# EasyEDA Pro project 第十五届蓝桥杯EDA赛项模拟试题二（嘉立创EDA提供）.eprj, board PCB-PockerMultimater1 (continued)
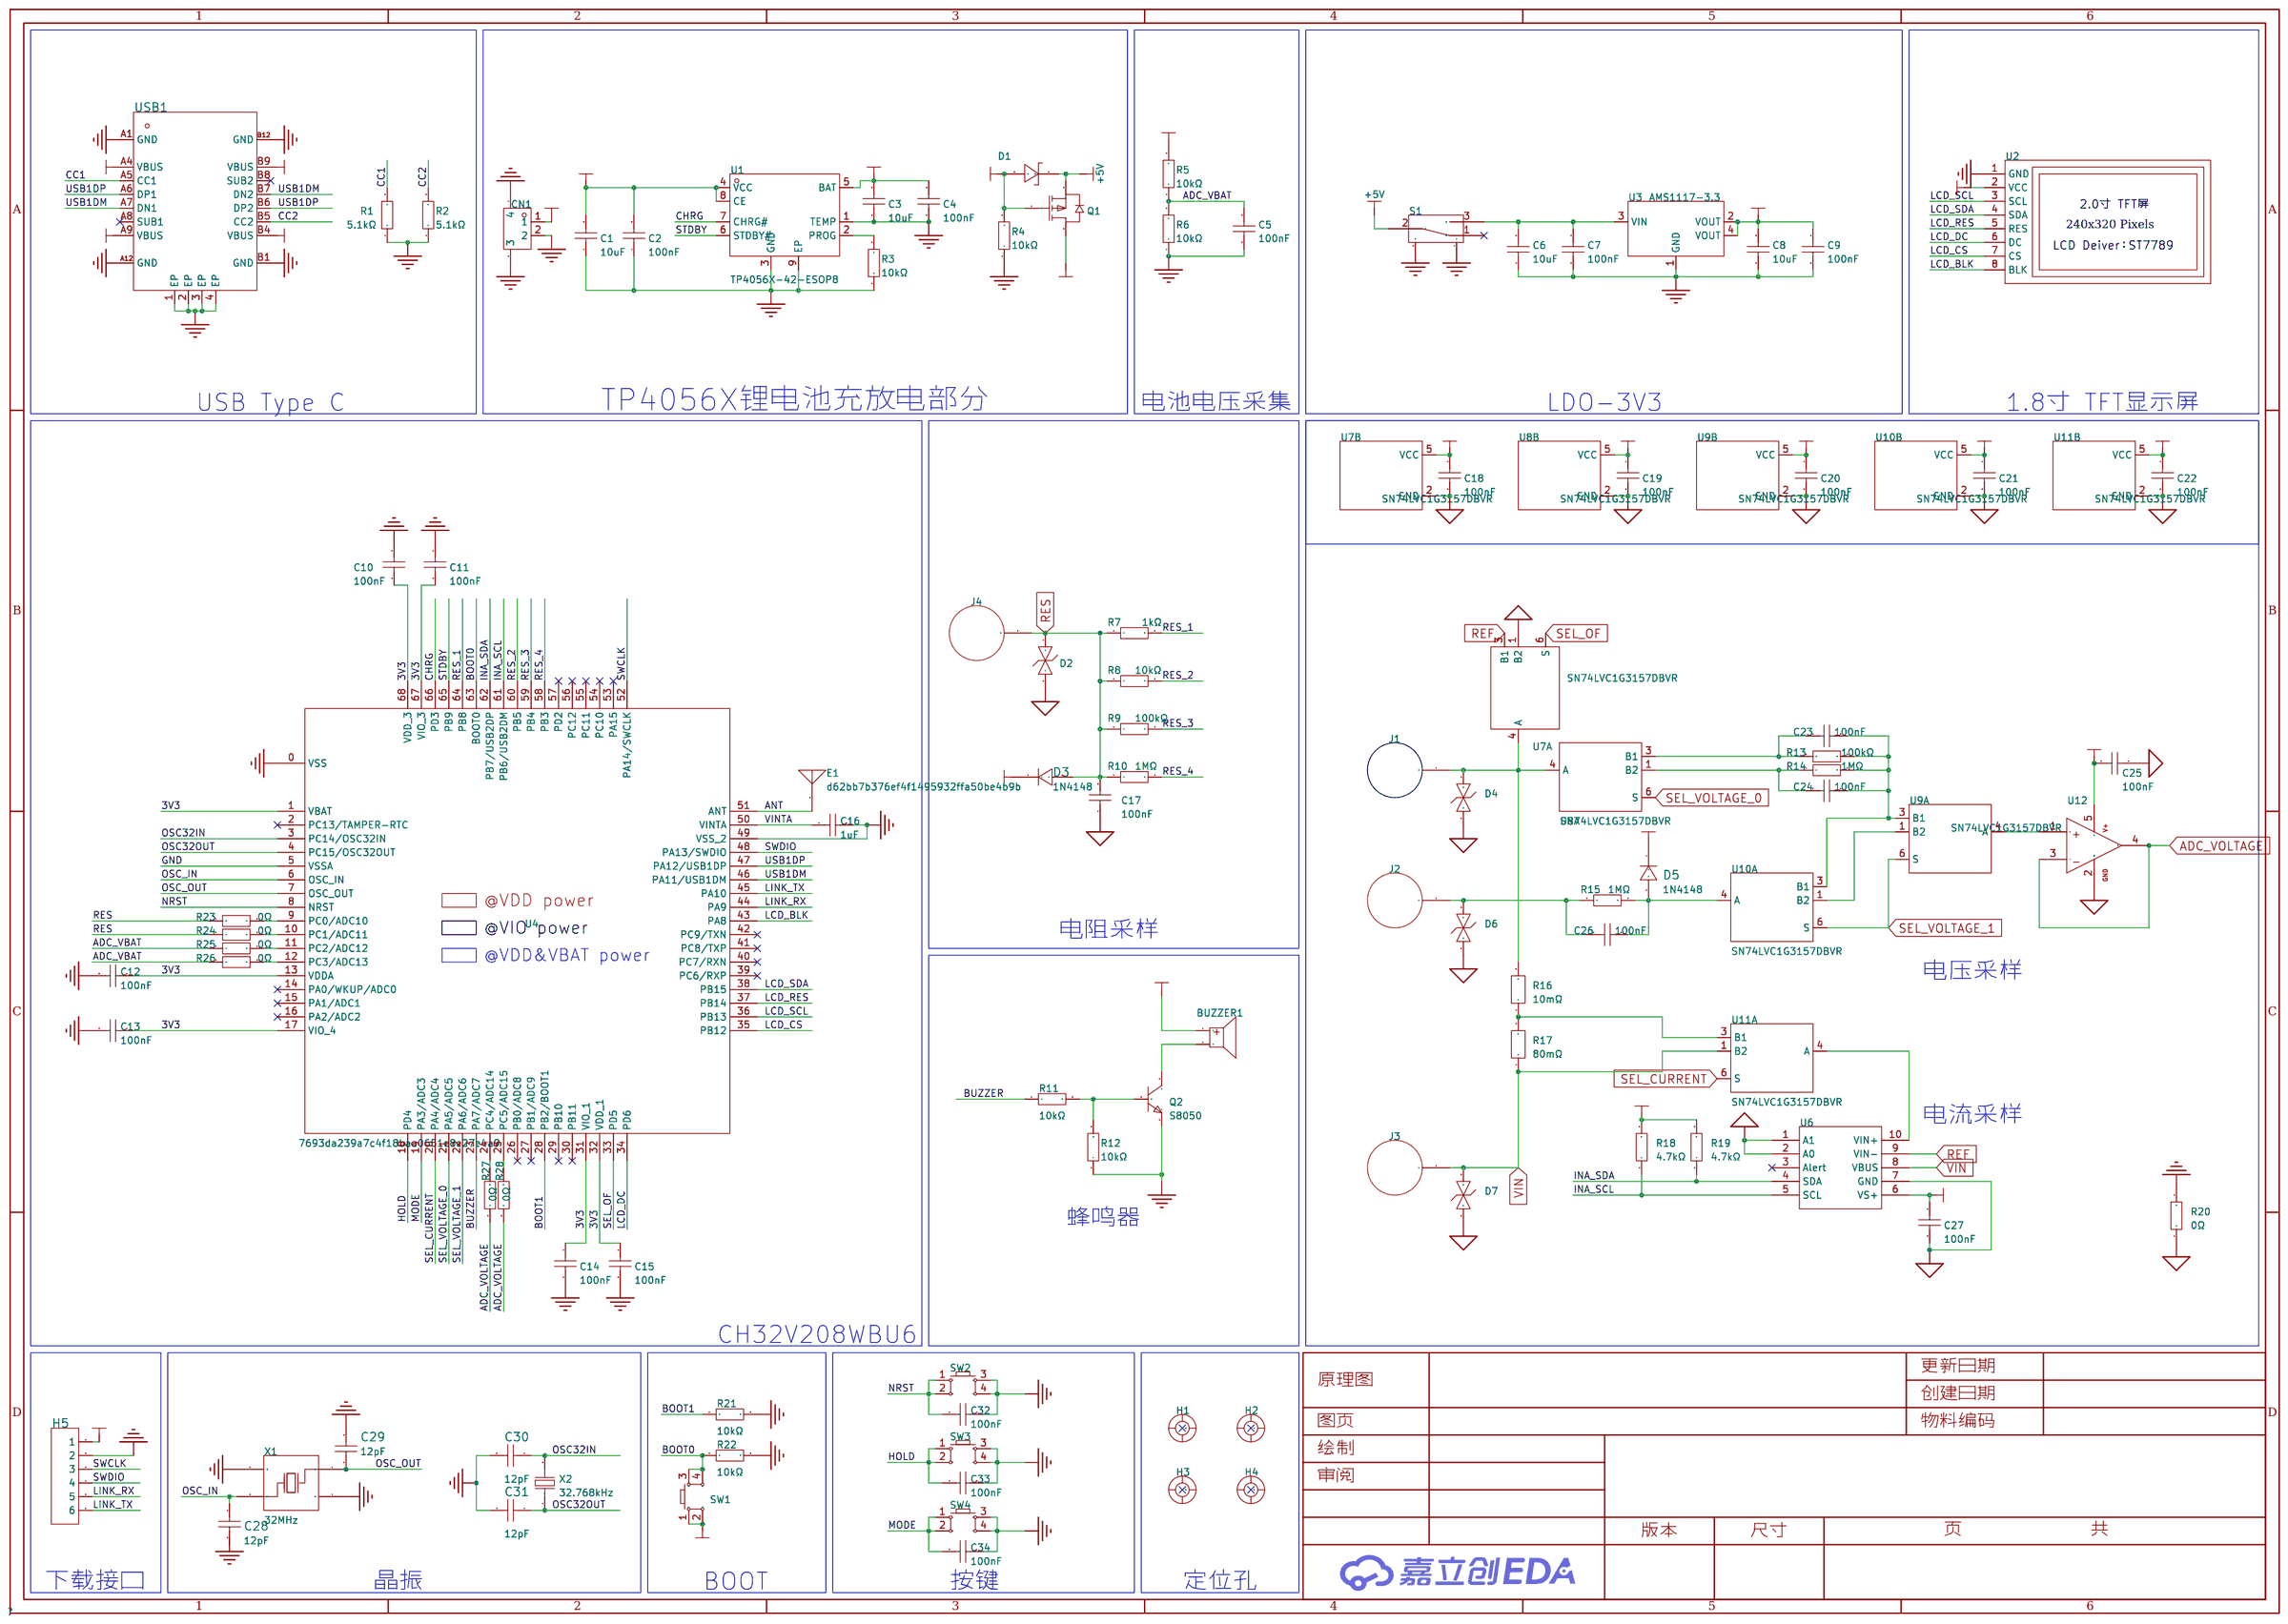
[diagram p0: schematic sheet]
## Routing (per net, layer and track width the routed paths; a pad name or vN(x,y) marks a point on that pad's centre or on a via; arc(x,y) is an arc through that point) (continued)
  Bottom Layer w0.152: v1(18.62,50.94) 19.09,50.47 21.03,50.47 ; v1(18.57,38.33) 18.57,37.82 v1(17.63,36.88) ; v1(18.62,52.89) 21.03,50.47 ; 21.03,50.47 v1(22.02,50.47)
  vias: v1(10.13,1.98) v1(13.92,16.15) v1(15.52,13.66) v1(17.22,19.53) v1(17.5,20.52) v1(18.64,45.19) v1(19.48,21.62) v1(20.22,2.46) v1(22.07,37.54) v1(22.1,26.31) v1(22.17,44.88) v1(22.17,42.83) v1(22.17,34.85) v1(22.17,21.95) v1(22.28,24.05) v1(22.53,29.39) v1(22.58,19.3) v1(23.62,22.66) v1(23.62,20.88) v1(23.62,18.73) v1(24.66,48.78) v1(25.53,47.68) v1(25.65,44.88) v1(25.65,42.57) v1(26.34,45.96) v1(27.33,45.39) v1(27.33,42.54) v1(30.1,45.52) v1(30.1,42.62) v1(31.75,29.54) v1(31.76,23.39) v1(32.41,28.04) v1(33.5,23.65) v1(33.81,16.79) v1(34.52,29.54) v1(34.7,2.51) v1(35.23,27.79) v1(35.97,48.92) v1(36.47,23.37) v1(36.93,16.69) v1(38.3,48.95) v1(39.5,46.18) v1(39.92,23.37) v1(41.05,46.18) v1(41.33,44.32) v1(43.38,49.07) v1(43.89,24.66) v1(43.94,19.41) v1(44.12,27.99) v1(44.96,46.91) v1(45.26,40.64) v1(45.31,21.54) v1(45.57,30.76) v1(45.67,24.87) v1(45.95,27.48) v1(46.05,28.73) v1(46.38,48.99) v1(46.79,16.51) v1(47.19,46.91) v1(47.5,45.47) v1(49.05,31.67) v1(48.99,24.87) v1(49.1,27.99) v1(49.33,9.55) v1(49.99,30.33) v1(50.09,1.55) v1(50.29,46.91) v1(50.27,33.43) v1(50.39,26.06) v1(50.52,43.89) v1(50.77,40.72) v1(50.93,38.91) v1(51.14,45.47) v1(51.18,36.73) v1(51.41,49.02) v1(57.95,15.43) v1(58.98,20.62) v1(60.3,15.95) v1(61.79,13.67) v1(62.46,1.93) v1(63.19,18.72) v1(64.39,13.67) v1(65.96,10.11) v1(67.59,12.32)
GND: length 177.2
  Top Layer w0.152: 14.14,27.98 v1(14.88,27.98) ; 14.14,27.98 R4.1 12.23,27.95 C2.1 12.15,27.91 C1.1 ; 14.14,27.98 13.57,27.98 ; X1.2 20.5,75.7 v1(20.76,75.44) ; v1(7.26,54.22) 7.26,54.23 ; 41.15,79.15 41.45,79.15 v1(41.96,79.65) v1(43.08,80.77) v1(44.59,82.28) v1(46.17,83.87) v1(47.95,85.64) v1(49.35,87.05) v1(50.81,88.51) v1(51.91,89.6) v1(53.62,91.31) v1(55.3,91.31) v1(56.7,91.31) v1(58.14,91.31) v1(59,92.18) v1(59,93.19) ; C3.1 v1(8.54,31.19) ; C6.1 8.93,52.84 C7.2 ; v1(17.76,80.12) v1(17.04,79.4) v1(17.04,76) 17.6,75.44 v1(19.03,75.44) v1(20.76,75.44) ; v1(17.76,80.12) 18.3,79.59 X1.4 ; v1(17.76,80.12) v1(19.55,80.12) v1(21.3,80.12) v1(23.87,80.12) ; USB1.B1 v1(8.56,15.95) ; 39.01,79.86 v1(39.9,79.86) v1(41,80.95) v1(41.9,81.85) v1(43.07,83.03) v1(44.35,84.31) v1(45.67,85.62) v1(46.82,86.78) v1(48,87.96) v1(49.1,89.06) v1(50.42,90.38) v1(51.53,91.48) 52.5,92.46 v1(52.98,92.46) v1(55.07,92.46) 56.67,92.46 v1(56.97,92.76) v1(56.97,94.08) ; v1(27.48,76.25) 27.46,76.28 v1(25.7,76.28) 24.52,76.28 24.24,76 24.24,75.62 v1(24.13,75.51) 22.7,75.51 22.65,75.46 ; C29.1 22.05,75.59 21.9,75.44 v1(20.76,75.44) ; C12.2 28.08,73.49 v1(28.08,70.65) 28.07,70.64 27.97,70.64 ; v1(23.87,80.12) 24.13,79.86 24.13,78.84 25.21,77.76 v1(25.35,77.76) 25.5,77.6 U4.5 ; v1(23.87,80.12) 23.88,80.13 v1(23.88,81.81) 23.7,81.99 C31.2 v1(21.25,81.99) v1(20.3,81.99) 19.66,82.63 v1(19.66,83.74) v1(19.66,85.41) v1(19.66,86.94) 20.2,87.49 v1(21.06,87.49) C30.2 v1(24.02,87.49) v1(24.64,86.87) 24.64,86.23 25.2,85.67 v1(25.58,85.67) 25.69,85.57 v1(25.69,84.14) v1(25.69,82.63) v1(25.69,81.08) 25.69,80.28 v1(26.39,79.58) 27.69,79.58 v1(27.71,79.55) 28.42,79.55 ; R20.2 15.01,40.78 C8.1 16.67,41.64 C9.2 ; U4.49 37.4,78.4 U4.0 ; 10.97,17.28 v1(12.14,17.28) ; R12.1 63.93,25.8 Q2.2 ; v1(14.61,37.27) C5.2 13.05,37.14 13.05,35.52
  Top Layer w0.508: v1(58.69,41.58) 60.19,41.58 SW3.3 ; SW2.3 60.01,49.76 v1(58.21,49.76) ; C16.2 v1(45.9,79.81) ; 7.27,22.17 v1(8.67,22.17) ; v1(60.81,25.78) 62.24,25.78 R12.1 ; 8.47,31.92 10.32,31.92 10.35,31.95 ; SW4.3 60.16,33.34 v1(58.54,33.34) ; v1(2.28,27.14) 2.28,28.52 CN1.3 2.2,30.2 2.7,30.69 CN1.2 5.88,30.67 v1(7.89,30.67) ; v1(12.14,20.29) 11,20.29 R1.1 ; 30.45,84.35 v1(30.43,84.33) C11.1 32.11,83.07 C10.2 ; SW3.4 68.56,41.55 v1(68.56,40.1) ; v1(68.66,32.09) 68.66,33.29 SW4.4 ; C6.1 v1(7.26,54.22) ; v1(68.46,48.34) 68.46,49.76 SW2.4 ; R22.2 19.59,97.28 v1(18.75,97.28) ; C15.2 38.54,66.47 R21.2 v1(35.25,65.49) 35.28,65.46 ; U3.1 13.58,51.05 ; CN1.4 2.2,36.48 ; C34.1 v1(63.3,39.69) ; C32.1 v1(62.43,56.11)
  Bottom Layer w0.152: v1(58.69,41.58) 58.54,41.43
  vias: v1(2.2,36.68) v1(3.1,64.69) v1(3.1,63.91) v1(3.43,10.16) v1(3.43,9.37) v1(4.19,64.69) v1(4.19,63.91) v1(4.52,10.16) v1(4.52,9.37) v1(5.51,83.72) v1(5.51,82.93) v1(5.56,77.01) v1(5.56,76.23) v1(6.6,83.72) v1(6.6,82.93) v1(6.65,77.01) v1(6.65,76.23) v1(7.92,38.63) v1(7.92,37.85) v1(9.01,38.63) v1(9.01,37.85) v1(11.84,39.88) v1(11.84,39.09) v1(12.92,39.88) v1(12.92,39.09) v1(12.95,97.33) v1(12.95,96.55) v1(13.16,79.48) v1(13.16,78.69) v1(13.23,74.14) v1(13.23,73.36) v1(13.31,87.5) v1(13.31,86.72) v1(13.39,83.36) v1(13.39,82.58) v1(13.58,51.25) v1(13.79,61.16) v1(13.79,60.38) v1(14.04,97.33) v1(14.04,96.55) v1(14.24,79.48) v1(14.24,78.69) v1(14.32,74.14) v1(14.32,73.36) v1(14.4,87.5) v1(14.4,86.72) v1(14.47,83.36) v1(14.47,82.58) v1(14.55,54.99) v1(14.55,54.2) v1(14.88,61.16) v1(14.88,60.38) v1(15.47,46.99) v1(15.47,46.2) v1(15.64,54.99) v1(15.64,54.2) v1(16.56,46.99) v1(16.56,46.2) v1(20.07,62) v1(20.07,61.21) v1(21.15,62) v1(21.15,61.21) v1(24.13,78.81) v1(40.79,88.44) v1(40.79,87.66) v1(41.88,88.44) v1(41.88,87.66) v1(43.08,92.53) v1(43.08,91.75) v1(43.59,97.33) v1(43.59,96.55) v1(44.16,92.53) v1(44.16,91.75) v1(44.32,64.52) v1(44.32,63.73) v1(44.67,97.33) v1(44.67,96.55) v1(45.03,89.51) v1(45.03,88.72) v1(45.41,64.52) v1(45.41,63.73) v1(46.12,89.51) v1(46.12,88.72) v1(47.02,61.16) v1(47.02,60.38) v1(47.75,65.18) v1(47.75,64.39) v1(48.1,61.16) v1(48.1,60.38) v1(48.84,65.18) v1(48.84,64.39) v1(53.03,85.67) v1(53.03,84.89) v1(53.8,65) v1(53.8,64.21) v1(54.12,85.67) v1(54.12,84.89) v1(54.88,65) v1(54.88,64.21) v1(56.08,69.75) v1(56.08,68.96) v1(56.16,60.76) v1(56.16,59.97) v1(57.12,87.86) v1(57.12,87.07) v1(57.17,69.75) v1(57.17,68.96) v1(57.25,60.76) v1(57.25,59.97) v1(57.86,44.14) v1(57.86,43.36) v1(58.21,87.86) v1(58.21,87.07) v1(58.19,63.7) v1(58.19,62.92) v1(58.67,84.61) v1(58.67,83.82) v1(58.95,44.14) v1(58.95,43.36) v1(59.28,63.7) v1(59.28,62.92) v1(59.36,30.56) v1(59.36,29.77) v1(59.76,84.61) v1(59.76,83.82) v1(59.84,68.35) v1(59.84,67.56) v1(60.45,30.56) v1(60.45,29.77) v1(60.93,68.35) v1(60.93,67.56) v1(63.68,23.5) v1(63.68,22.71) v1(63.88,50.24) v1(63.88,49.45) v1(64.39,35.08) v1(64.39,34.29) v1(64.44,30.3) v1(64.44,29.51) v1(64.77,43.21) v1(64.77,42.42) v1(64.76,23.5) v1(64.76,22.71) v1(64.97,50.24) v1(64.97,49.45) v1(65.47,35.08) v1(65.47,34.29) v1(65.53,30.3) v1(65.53,29.51) v1(65.86,43.21) v1(65.86,42.42) v1(66.14,58.19) v1(66.14,57.4) v1(67.23,63.86) v1(67.23,63.07) v1(67.23,58.19) v1(67.23,57.4) v1(67.31,87.12) v1(67.31,86.33) v1(67.39,81.97) v1(67.39,81.18) v1(67.49,92.02) v1(67.49,91.24) v1(67.49,74.8) v1(67.49,74.02) v1(68.25,28.45) v1(68.25,27.66) v1(68.32,63.86) v1(68.32,63.07) v1(68.4,87.12) v1(68.4,86.33) v1(68.47,81.97) v1(68.47,81.18) v1(68.57,92.02) v1(68.57,91.24) v1(68.57,74.8) v1(68.57,74.02) v1(69.34,28.45) v1(69.34,27.66)
VBAT: length 2.2
  Top Layer w0.508: 8.57,35.42 8.49,35.5 ; C3.2 8.54,35.42
  vias: v1(5,33.96) v1(5.03,33.17) v1(6.28,33.94) v1(6.28,33.17) v1(7.38,33.94) v1(7.39,33.17) v1(15.98,24.51) v1(15.98,23.65) v1(15.98,22.86)
VBUS: length 13.6
  Top Layer w0.152: U1.8 13.08,29.55
  Top Layer w0.508: U1.4 18.5,33.36 19.05,32.82 19.05,27.25 18.24,26.45 R4.2
  vias: v1(9.14,29.26) v1(9.14,28.09) v1(9.09,27.22)
VIN: length 41.1
  Top Layer w0.152: U6.8 43.63,38.56 43.64,38.56 43.64,37.16 43.35,36.87 U11.1
  Top Layer w0.508: v1(41.81,17.6) 41.81,15.81 41.8,15.8 41.8,8.53 J3.1 ; U11.1 41.19,36.87 40.67,36.35 40.67,30.91 40.31,30.56 38.35,30.56 38.06,30.26 v1(38.06,29.84) v1(38.06,28.91) v1(38.06,27.98) R17.1
  Bottom Layer w0.508: v1(38.06,27.98) 38.06,18.69 39.14,17.6 v1(41.81,17.6)
VINTA: length 5.6
  Top Layer w0.152: 44.56,78.8 U4.50
ADC_VBAT: length 51.9
  Top Layer w0.152: R26.1 21.94,69.68 R25.1 17.54,70.76 16.71,69.94 v1(16.71,67.46) ; v1(16.71,61.92) 19.69,58.95 19.69,38.15 19.02,37.49 16.03,37.49 15.57,37.95 12.15,37.95 11.52,37.32
  Top Layer w0.508: C5.1 11.52,35.55 R6.2 10,35.52 9.98,35.5
  Bottom Layer w0.152: v1(16.71,61.92) v1(16.71,67.46)
ADC_VOLTAGE: length 58.6
  Top Layer w0.152: U12.4 v1(34.44,35.27) ; U12.3 v1(33.75,39.24) ; v1(31.29,54.15) 31.22,54.08 28.07,54.08 27.66,54.48 27.66,66.12 28.14,66.59 R27.1 R28.1 ; v1(39.04,52.3) v1(32.21,52.3)
  Bottom Layer w0.152: v1(31.29,54.15) 31.98,54.15 32.21,53.92 v1(32.21,52.3) ; v1(34.44,35.27) 33.47,35.27 33.02,35.71 33.02,38.94 33.32,39.24 v1(33.75,39.24) 33.75,39.8 34.11,40.16 39.9,40.16 40.11,40.36 40.11,51.23 v1(39.04,52.3)
ANT: length 26.4
  Top Layer w0.152: 58.15,94.1 58.15,92.24 57.81,91.9 53.16,91.9 40.47,79.2 U4.51
BOOT0: length 47.4
  Top Layer w0.152: v1(21.36,98.83) 21.35,98.84 R22.1 19.53,98.96 SW1.3 SW1.4 ; v1(19.33,91.11) 19.56,91.34 33.71,91.34 34.01,91.03 34.01,81 33.8,80.79 U4.63
  Bottom Layer w0.152: v1(21.36,98.83) 21.36,91.82 20.85,91.31 19.53,91.31 v1(19.33,91.11)
BOOT1: length 4.2
  Top Layer w0.152: U4.28 35.8,70.93 35.25,70.38 R21.1
BUZZER: length 79.9
  Top Layer w0.152: U4.23 33.8,71.43 31.28,68.91 29.16,68.91 27.28,67.03 27.28,53.67 27.38,53.57 54.97,53.57 55.55,52.98 55.55,27.66 55.85,27.36 R11.1
CC1: length 2
  Top Layer w0.203: R1.2 9.42,20.25 USB1.A5
CC2: length 2
  Top Layer w0.203: USB1.B5 9.43,17.25 R2.2
CHRG: length 114.5
  Top Layer w0.152: U1.7 v1(11.07,30.82) ; U4.66 32.6,80.81 33.02,81.23 33.02,89.33 32.31,90.04 11,90.04 10.31,89.36 10.31,68.03 12.69,65.66 23.14,65.66 25.3,63.5 25.3,48.21 25.09,48.01 v1(22.73,48.01)
  Bottom Layer w0.152: v1(11.07,30.82) 12.92,30.82 19.81,37.72 19.81,47.32 20.5,48.01 v1(22.73,48.01)
HOLD: length 83.6
  Top Layer w0.152: v1(33.07,54.79) 55.68,54.79 56.31,54.15 56.31,48.16 56.64,47.83 C33.2 60.19,46.18 SW3.1 SW3.2 ; U4.18 31.8,71.32 30.66,70.18 28.55,70.18 25.86,67.49 25.86,49.05 26.22,48.69 v1(32.8,48.69)
  Bottom Layer w0.152: v1(33.07,54.79) 32.74,54.46 32.74,48.74 v1(32.8,48.69)
INA_SCL: length 128.7
  Top Layer w0.152: R18.1 45.48,41.61 42.9,41.61 42.62,41.88 42.62,42.77 42.63,42.78 U6.5 42.63,46.98 42.16,47.45 26.48,47.45 25.76,46.72 21.35,46.72 20.93,47.14 20.93,52.27 21.06,52.4 23.62,52.4 24.23,53.01 24.23,63.13 22.82,64.54 12.36,64.54 9.22,67.68 9.22,91.41 9.7,91.9 34.42,91.9 34.77,91.54 34.77,80.95 34.6,80.78 U4.61
INA_SDA: length 125.7
  Top Layer w0.152: U4.62 34.2,80.81 34.42,81.03 34.42,91.31 34.09,91.64 10.03,91.64 9.55,91.16 9.55,67.72 12.45,64.82 22.9,64.82 24.54,63.18 24.54,52.2 23.75,51.41 21.69,51.41 21.18,50.9 21.18,47.56 21.77,46.98 25.64,46.98 26.36,47.7 42.27,47.7 43.13,46.84 U6.4 43.13,42.49 43.36,42.27 R19.1
LCD_BLK: length 45.8
  Top Layer w0.152: 64.6,66.11 65.88,66.11 66.14,66.37 66.14,79.53 65.61,80.06 62.71,80.06 62.26,79.6 62.26,76.25 62,76 U4.43
LCD_CS: length 29.2
  Top Layer w0.152: 64.6,68.65 63.33,68.65 63.02,68.96 63.02,72.11 62.33,72.8 U4.35
LCD_DC: length 26.8
  Top Layer w0.152: v1(61.01,72.06) 60.93,71.98 U4.34 ; v1(63.55,72.06) 63.73,72.06 64.6,71.19
  Bottom Layer w0.152: v1(61.01,72.06) v1(63.55,72.06)
LCD_RES: length 25.7
  Top Layer w0.152: 64.6,73.73 v1(63.25,73.73) ; v1(61.14,73.76) 60.98,73.6 U4.37
  Bottom Layer w0.152: v1(63.25,73.73) 63.21,73.76 v1(61.14,73.76)
LCD_SCL: length 29.9
  Top Layer w0.152: U4.36 62.1,73.2 62.51,73.61 62.51,78.49 62.87,78.84 63.7,78.84
LCD_SDA: length 27.4
  Top Layer w0.152: v1(59.36,74.39) 58.97,74 U4.38 ; 64.6,76.27 64.53,76.2 v1(63.22,76.2)
  Bottom Layer w0.152: v1(59.36,74.39) 62.17,74.39 62.28,74.5 62.28,75.97 62.51,76.2 v1(63.22,76.2)
LINK_RX: length 34.7
  Top Layer w0.152: v1(37.31,93.7) 37.24,93.78 37.24,96.45 H5.5 ; U4.44 44.42,76.4 v1(45.21,77.19)
  Bottom Layer w0.152: v1(37.31,93.7) 37.95,93.07 37.95,76.94 38.25,76.63 44.65,76.63 v1(45.21,77.19)
LINK_TX: length 30.4
  Top Layer w0.152: v1(43.92,77.19) 43.53,76.8 U4.45 ; v1(38.3,93.9) 38.3,95.93 H5.6
  Bottom Layer w0.152: v1(43.92,77.19) 38.68,77.19 38.3,77.57 38.3,93.67
MODE: length 89.5
  Top Layer w0.152: v1(34.09,49.24) 34.08,49.25 26.26,49.25 26.11,49.4 26.11,67.38 28.66,69.93 30.76,69.93 32.2,71.36 U4.19 ; v1(34.09,54.2) 55.32,54.2 55.98,53.54 55.98,40.16 56.44,39.69 C34.2 60.17,37.89 SW4.1 SW4.2
  Bottom Layer w0.152: v1(34.09,49.24) v1(34.09,54.2)
NRST: length 60.4
  Top Layer w0.152: U4.8 31.88,76.4 v1(31.93,76.35) ; v1(31.98,62.43) 32.03,62.38 32.03,55.48 32.16,55.35 54.86,55.35 55.63,56.11 C32.2 59.98,54.35 SW2.1 SW2.2
  Bottom Layer w0.152: v1(31.93,76.35) 31.98,76.3 v1(31.98,62.43)
OSC32IN: length 16.3
  Top Layer w0.152: X2.2 22.73,85.96 C30.1 24.17,86.09 25.04,85.22 25.04,80.01 26.65,78.4 31.07,78.4
OSC32OUT: length 14
  Top Layer w0.152: U4.4 26.5,78 24.59,79.91 24.59,83.01 24.21,83.39 C31.1 22.79,83.46 X2.1
OSC_IN: length 11.3
  Top Layer w0.152: X1.3 20.75,78.72 C28.1 23.46,78.72 24.98,77.2 U4.6
OSC_OUT: length 14.2
  Top Layer w0.152: U4.7 30.98,76.84 23.41,76.84 23.26,76.99 C29.2 22.47,76.8 21.85,76.8 21.74,76.91 21.74,77.35 21.49,77.6 19.62,77.6 19.51,77.5 19.51,76.91 19.32,76.72 X1.1
REF: length 33.6
  Top Layer w0.152: v1(24.94,32.82) 25.22,32.54 U7.3 ; U6.9 v1(44.13,41.07)
  Bottom Layer w0.152: v1(24.94,32.82) 24.94,31.19 25.25,30.89 43.54,30.89 44.15,31.5 44.15,41.06 v1(44.13,41.07)
RES: length 119
  Top Layer w0.152: C17.2 57.18,17.59 D3.2 ; R23.1 21.93,72.12 R24.1 17.56,71.86 15.75,70.05 15.75,66.55 16.28,66.01 23.14,66.01 25.6,63.55 25.6,48.82 26.37,48.06 52.6,48.06 53.19,47.47 53.19,43.46 53.21,43.44 ; 53.21,43.44 53.21,43.66 ; 53.21,43.44 53.21,23.98 52.65,23.42 49.2,23.42 48.01,22.22 48.01,18.03 48.5,17.54 R7.1 R8.1 R10.1 55.43,17.54
  Top Layer w0.508: J4.1 55.23,9.77 D2.1 55.23,16.67 55.51,16.94 D3.2
RES_1: length 159.1
  Top Layer w0.152: R7.2 49.1,19.28 49.1,21.97 49.91,22.78 53.54,22.78 53.7,22.94 53.7,49.91 v1(50.7,52.91) ; v1(24.31,51) 24.44,51 24.79,51.36 24.79,63.29 22.93,65.15 12.47,65.15 9.8,67.82 9.8,90.09 10.29,90.58 33.52,90.58 33.76,90.34 33.76,81.13 33.4,80.77 U4.64
  Bottom Layer w0.152: v1(50.7,52.91) 50.7,55.45 50.24,55.91 25.3,55.91 25.19,55.8 25.19,51.89 v1(24.31,51)
RES_2: length 156.9
  Top Layer w0.152: U4.60 35,80.04 35.03,80.07 35.03,91.8 34.67,92.15 9.35,92.15 8.97,91.77 8.97,67.57 12.25,64.29 22.72,64.29 23.98,63.02 23.98,55.36 v1(23.66,55.04) ; v1(51.66,52.88) 51.87,52.88 54.1,50.66 54.1,22.53 53.95,22.38 51.31,22.38 50.7,21.77 50.7,19.23 R8.2
  Bottom Layer w0.152: v1(51.66,52.88) 51.66,55.83 51.33,56.16 24.79,56.16 23.67,55.04 v1(23.66,55.04)
RES_3: length 157.6
  Top Layer w0.152: R9.2 52.2,19.33 52.2,21.41 52.83,22.05 54.25,22.05 54.61,22.4 54.61,51.39 53.22,52.78 v1(52.73,52.78) ; U4.59 35.4,91.93 34.93,92.41 9.17,92.41 8.71,91.94 8.71,67.47 12.14,64.03 22.61,64.03 23.67,62.97 23.67,56.25 v1(23.2,55.77)
  Bottom Layer w0.152: v1(52.73,52.78) 52.73,56.08 52.32,56.49 23.91,56.49 v1(23.2,55.77)
RES_4: length 158.6
  Top Layer w0.152: R10.2 53.72,19.27 53.72,21.16 54.36,21.79 54.84,21.79 55.14,22.1 55.14,52.63 54.86,52.91 v1(53.85,52.91) ; U4.58 35.8,92.04 35.18,92.66 9.07,92.66 8.46,92.05 8.46,67.36 12.04,63.78 22.5,63.78 23.37,62.92 23.37,57.02 v1(22.86,56.52)
  Bottom Layer w0.152: v1(53.85,52.91) 53.85,56.21 53.21,56.84 23.19,56.84 v1(22.86,56.52)
SEL_CURRENT: length 65
  Top Layer w0.152: U4.20 32.6,71.36 30.91,69.67 28.76,69.67 26.37,67.28 26.37,50.19 26.54,50.01 v1(41.04,50.01) ; v1(46.76,39.37) 45.85,39.37 45.18,38.7 U11.6
  Bottom Layer w0.152: v1(41.04,50.01) 48.16,50.01 48.97,49.2 48.97,38.96 48.56,39.37 v1(46.76,39.37)
SEL_OF: length 57.9
  Top Layer w0.152: v1(29.16,55.04) 28.28,55.04 28.17,55.14 28.17,62.61 28.75,63.19 39.24,63.19 39.4,63.35 39.4,68.89 39.12,69.16 38.1,69.16 37.8,69.46 U4.33 ; U7.6 28.43,28.98 28.47,29.03 28.47,32.6 28.5,32.62 28.5,33.06 28.57,33.14 v1(28.57,38.89)
  Bottom Layer w0.152: v1(29.16,55.04) 28.93,54.81 28.93,40.77 29.31,40.39 29.31,39.62 v1(28.57,38.89)
SEL_VOLTAGE_0: length 43.2
  Top Layer w0.152: U8.6 27.62,35.42 27.94,35.74 27.94,39.36 v1(28.57,40) ; U4.21 33,71.35 31.06,69.42 28.87,69.42 26.62,67.17 26.62,51.51 26.77,51.36 v1(28.39,51.36)
  Bottom Layer w0.152: v1(28.39,51.36) 28.39,40.18 v1(28.57,40)
SEL_VOLTAGE_1: length 52.9
  Top Layer w0.152: U4.22 33.4,71.39 31.17,69.16 28.97,69.16 26.87,67.07 26.87,52.61 27.06,52.43 v1(30.86,52.43) ; U10.6 v1(34.93,42.92) ; U9.6 v1(32.44,35.25)
  Bottom Layer w0.152: 32.44,42.9 32.44,46.79 32.13,47.09 29.49,47.09 29.38,47.2 29.38,52.22 29.59,52.43 v1(30.86,52.43) ; 32.44,42.9 32.46,42.92 v1(34.93,42.92) ; 32.44,42.9 v1(32.44,35.25)
STDBY: length 115.3
  Top Layer w0.152: 11.15,32.08 v1(11.16,32.09) U1.6 ; U4.65 33,80.78 33.32,81.1 33.32,89.71 32.72,90.32 10.64,90.32 10.06,89.74 10.06,67.93 12.58,65.41 23.03,65.41 25.04,63.39 25.04,49.86 24.46,49.28 v1(22.61,49.28)
  Bottom Layer w0.152: v1(11.16,32.09) 13.83,32.09 19.56,37.82 19.56,49.45 19.71,49.61 22.28,49.61 v1(22.61,49.28)
SWCLK: length 22.8
  Top Layer w0.152: H5.3 31.68,93.57 32.21,93.04 37.62,93.04 38.2,92.46 U4.52
SWDIO: length 34
  Top Layer w0.152: v1(39.88,93.07) 40.77,93.95 40.77,97.97 40.23,98.5 34.54,98.5 34.44,98.39 34.44,97.14 H5.4 ; U4.48 39.35,78 39.58,78.23 41.22,78.23 v1(41.25,78.27)
  Bottom Layer w0.152: v1(39.88,93.07) 38.96,93.07 38.71,92.81 38.71,78.46 38.9,78.27 v1(41.25,78.27)
USB1DM: length 119
  Top Layer w0.152: 8.56,18.75 8.61,18.8 8.61,19.58 8.44,19.75 USB1.B7 ; 8.56,18.75 USB1.A7 ; 8.56,18.75 19.94,18.75 20.37,19.18 20.37,30.81 20.26,30.92 19.99,30.92 19.88,31.02 19.88,32.33 19.99,32.44 20.26,32.44 20.37,32.55 20.37,33.43 20.26,33.54 20.2,33.54 20.09,33.65 20.09,34.96 20.2,35.06 20.26,35.06 20.37,35.17 20.37,36.48 20.26,36.59 20.2,36.59 20.09,36.69 20.09,38 20.2,38.11 20.26,38.11 20.37,38.22 20.37,39.53 20.26,39.64 20.2,39.64 20.09,39.74 20.09,41.05 20.2,41.16 20.26,41.16 20.37,41.27 20.37,42.58 20.26,42.68 20.2,42.68 20.09,42.79 20.09,44.1 20.2,44.21 20.26,44.21 20.37,44.31 20.37,45.62 20.26,45.73 20.2,45.73 20.09,45.84 20.09,47.15 20.2,47.26 20.26,47.26 20.37,47.36 20.37,48.67 20.26,48.78 20.2,48.78 20.09,48.89 20.09,50.2 20.2,50.3 20.26,50.3 20.37,50.41 20.37,51.72 20.26,51.83 20.2,51.83 20.09,51.94 20.09,53.24 20.2,53.35 20.26,53.35 20.37,53.46 20.37,54.77 20.26,54.88 20.2,54.88 20.09,54.98 20.09,56.29 20.2,56.4 20.26,56.4 20.37,56.51 20.37,57.05 21.64,58.32 v1(22.83,58.32) ; U4.46 42.83,77.2 43.42,77.79 43.56,77.65 43.62,77.65 43.7,77.72 45.43,77.72 45.51,77.65 v1(51.44,77.65)
  Bottom Layer w0.152: v1(51.44,77.65) 51.94,77.14 51.94,61.04 49.22,58.32 v1(22.83,58.32)
USB1DP: length 119.1
  Top Layer w0.152: U4.47 42.8,77.6 43.29,78.09 48.55,78.09 48.71,78.25 51.94,78.25 v1(52.24,77.95) ; v1(22.81,57.5) 22.48,57.17 20.93,57.17 20.68,56.92 20.68,18.75 20.18,18.25 USB1.B6 6.52,18.25 6.35,18.41 6.35,19.08 6.53,19.25 7.49,19.25 USB1.A6
  Bottom Layer w0.152: v1(52.24,77.95) 52.25,77.94 52.25,60.02 49.73,57.5 v1(22.81,57.5)
$1N2724: length 4.6
  Top Layer w0.152: U1.2 17.3,30.84 18.36,30.84 18.52,30.68 18.52,28.16 18.36,28.01 R3.2
$1N6482: length 8.3
  Top Layer w0.152: U9.4 29.81,35.43 29.81,36.16 30.02,36.37 35.51,36.37 35.66,36.53 35.66,37.86 U12.1
$1N6484: length 25.6
  Top Layer w0.152: 36.16,20.33 36.18,20.31 R17.2 ; 36.16,20.33 40.82,20.33 41.25,20.75 41.25,34.44 41.78,34.97 U11.3 ; 36.16,20.33 R16.1
$1N6487: length 47.1
  Top Layer w0.152: U8.4 25.11,35.46 24.64,35.46 24.36,35.18 24.36,29.36 24.74,28.98 U7.4
  Top Layer w0.508: v1(29.92,26.49) 32.89,26.49 R16.2 ; U7.4 25.22,28.28 25.2,28.26 v1(25.2,25.12) v1(25.2,23.97) v1(25.2,22.77) 25.2,16.89 24.76,16.46 18.97,16.46 18.68,16.17 D4.1 18.68,10.89 15.8,8 J1.1
  Bottom Layer w0.508: v1(29.92,26.49) 29.34,26.49 27.96,25.12 v1(25.2,25.12)
$1N6488: length 51.6
  Top Layer w0.152: D6.1 29.39,15.26 29.39,31.19 29.77,31.57 39.65,31.57 40.13,32.06 40.13,44.17 39.63,44.67 C26.1 37.51,44.76 R15.1
  Top Layer w0.508: D6.1 28.9,9.23 J2.1
$1N6489: length 10
  Top Layer w0.152: 36.09,42.97 36,43.05 R15.2 35.21,46.18 35.06,46.03 35.06,44.05 34.95,43.94 32.41,43.94 32.3,43.83 U10.4
$1N6490: length 3.2
  Top Layer w0.152: U8.1 27.05,39.28 ; 27.05,39.28 27.05,39.45 C24.1 ; 27.05,39.28 27.02,39.45 ; 27.02,39.45 27.02,39.46 ; 27.02,39.45 R14.1
$1N6491: length 4.2
  Top Layer w0.152: U8.3 24.16,38.12 23.81,38.47 R13.1 23.69,39.57 22.17,39.57
$1N6508: length 17.5
  Top Layer w0.152: C23.2 27,40.97 ; 29.68,40.9 29.63,40.85 U9.3 ; 29.68,40.9 C24.2 ; 29.68,40.9 31.12,40.9 31.39,41.17 31.39,44.35 31.63,44.58 32.19,44.58 32.3,44.69 U10.3
$1N6517: length 9.9
  Top Layer w0.152: U9.1 31.7,38.12 31.7,43.99 32.04,44.33 33.97,44.33 34.2,44.56 U10.1
$1N9045: length 5.6
  Top Layer w0.152: U11.4 44.38,34.97 44.25,35.1 44.25,37.49 44.63,37.88 U6.10
$1N10212: length 10.6
  Top Layer w0.152: 22.77,72.96 24.7,72.96 25.09,73.35 25.09,75.18 25.22,75.31 27.77,75.31 28.46,76 U4.9
$1N10257: length 11.4
  Top Layer w0.152: R24.2 24.74,71.86 25.34,72.46 25.34,74.8 25.6,75.06 27.94,75.06 28.48,75.6 U4.10
$1N10302: length 11.8
  Top Layer w0.152: 22.78,70.76 24.94,70.76 25.6,71.42 25.6,74.36 25.98,74.75 28.02,74.75 28.46,75.2 U4.11
$1N10388: length 12.7
  Top Layer w0.152: 22.81,69.66 25.54,69.66 26.01,70.13 26.01,74.09 26.29,74.37 28.35,74.37 28.78,74.8 U4.12
$1N10482: length 5.6
  Top Layer w0.152: U4.24 34.2,69.23 33.73,68.76 32.97,68.76 32.65,68.44 R27.2
$1N10485: length 4.8
  Top Layer w0.152: R28.2 33.84,68.34 34.6,69.09 U4.25
$1N61701: length 6.7
  Top Layer w0.152: Q2.3 66.3,20.75 BUZZER1.2
$1N61716: length 3.5
  Top Layer w0.152: Q2.1 63.87,27.31 R12.2 62.21,27.36 R11.2

## Copper pours and planes (outline as drawn; the poured copper is in the pictures)
3V3 on Top Layer: 10.52,50.24 12.01,50.24 12.22,50.04 12.22,45.49 13.31,44.4 17.5,44.4 17.83,44.07 17.83,42.67 17.63,42.47 14.28,42.47 13.18,41.38 13.18,41.28 8.64,41.28 8.61,41.3 8.61,44.17 8.84,44.4 10.21,44.4 10.52,44.7
+5V on Top Layer: 10.36,20.98 10.36,22.91 10.8,23.34 13.08,23.34 13.43,23 13.43,20.98
+5V on Bottom Layer: 13.41,21.01 13.41,22.93 12.54,23.8 9.78,23.8 4.34,29.62 4.34,36.81 6.4,39.93 6.4,47.3 4.32,49.38 1.83,49.38 1.75,49.3 1.75,47.07 2.18,46.63 4.29,46.63 5.05,42.06 3.48,39.73 3.15,30.1 11.14,21.01
AGND on Top Layer: 18.01,56.54 19.18,56.54 19.2,56.57 19.2,50 26.18,50.03 51.74,50.03 51.74,26.85 53.95,24.64 59.11,24.64 70.33,13.41 70.33,-0.58 10.06,-0.58 7.49,1.98 7.49,11.51 19.58,23.6 19.58,33.63 17.47,35.74 17.47,37.84 16.92,38.38 16.92,40.44 17.98,41.5 17.98,56.49 18.01,56.52
AGND on Bottom Layer: 18.01,56.54 19.18,56.54 19.2,56.57 19.2,50 26.18,50.03 51.74,50.03 51.74,26.85 53.95,24.64 59.11,24.64 70.33,13.41 70.33,-0.58 10.06,-0.58 7.49,1.98 7.49,11.51 19.58,23.6 19.58,33.63 17.47,35.74 17.47,37.84 16.92,38.38 16.92,40.44 17.98,41.5 17.98,56.49 18.01,56.52
GND on Top Layer: -1.5,101.4 70.89,101.4 70.89,-0.91 -1.5,-0.91
GND on Bottom Layer: -2.92,102.9 72.75,102.9 72.75,-2.67 -2.92,-2.67
VBAT on Top Layer: 16.64,22.43 13.79,22.43 13.74,22.48 13.74,23.8 14.91,24.97 16.64,24.97
VBAT on Top Layer: 12.62,32.66 7.66,32.66 7.66,32.05 7.29,31.67 4.55,31.67 4.39,31.52 4.39,34.48 4.44,34.51 7.33,34.51 7.47,34.24 13,34.24 13.11,34.14 13.11,33.15
VBAT on Bottom Layer: 4.43,34.44 7.45,34.44 7.85,34.05 7.85,31.87 7.31,31.55 8.36,26.64 9.53,25.3 16.41,24.79 16.48,24.87 16.48,22.38 16.66,22.2 13.93,22.2 13.93,23.82 13.82,23.93 9.09,24.79 6.88,27.46 6.12,29.16 5.38,29.79 4.37,30.43 4.37,33.33 4.39,33.35 4.39,34.4
VBUS on Top Layer: 8.18,21.79 6.86,21.79 6.31,21.55 5.11,21.21 5.11,16.64 5.05,16.59 6.58,16.59 6.71,16.46 6.71,16.33 6.86,16.18 8.18,16.18 8.31,16.31 8.31,16.89 8.2,16.99 6.22,16.99 6.22,20.6 8.25,21.01 8.25,21.72
VBUS on Top Layer: 8.13,21.74 8.14,21.75 8.17,21.75 8.17,29.75 8.6,30.05 12.95,30.05 13.08,29.92 13.08,29.11 13.11,29.08 11.74,29.08 11.49,28.84 11.49,27.44 11.43,27.38 11.43,25.09 11.4,25.07 12.98,25.07 13.22,25.31 13.22,26.92 14.61,26.92 14.68,26.85 14.68,25.22 13.59,24.13 11.35,24.13 11.33,24.1 10.29,24.1 10.16,23.98 10.16,22.15 9.46,21.14 8.13,21.06
$1N25880 on Top Layer: 2.08,50.6 2.08,52.2 9.81,52.2 10.14,51.86 10.14,47.66 9.93,47.45 8.56,47.45 6.91,49.1 6.91,50.14 2.23,50.14 2.06,50.32 2.06,50.57
